# EasyEDA Pro project 智能车.eprj, board PCB3
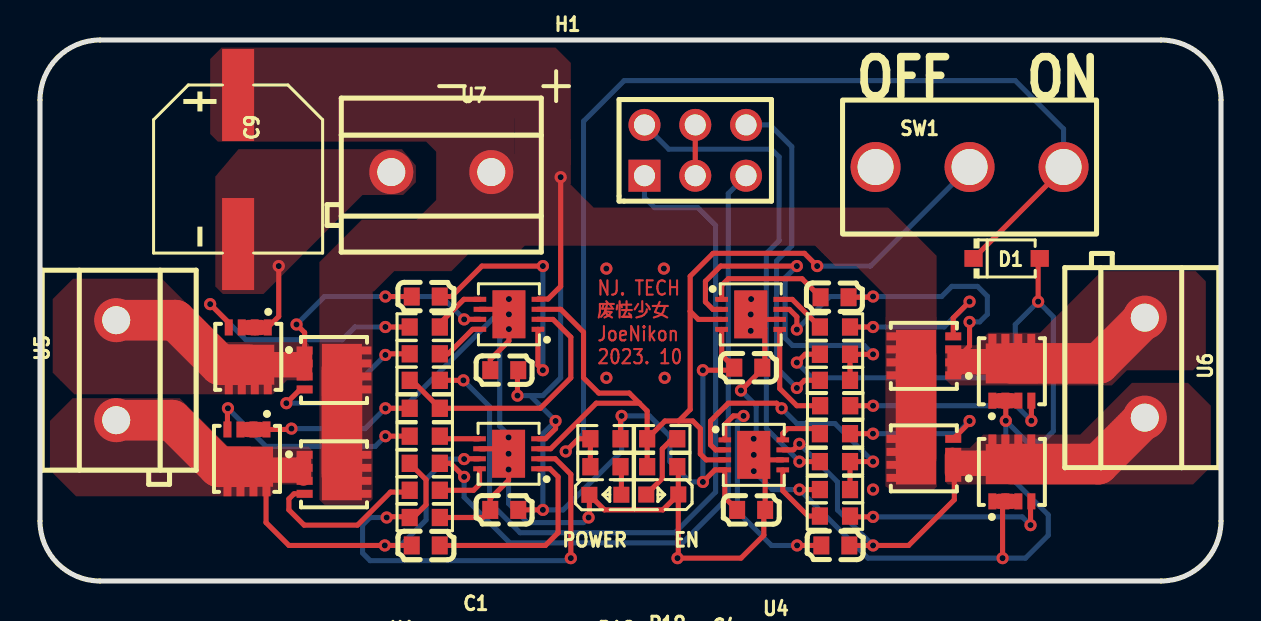
[diagram p12: board, top side]
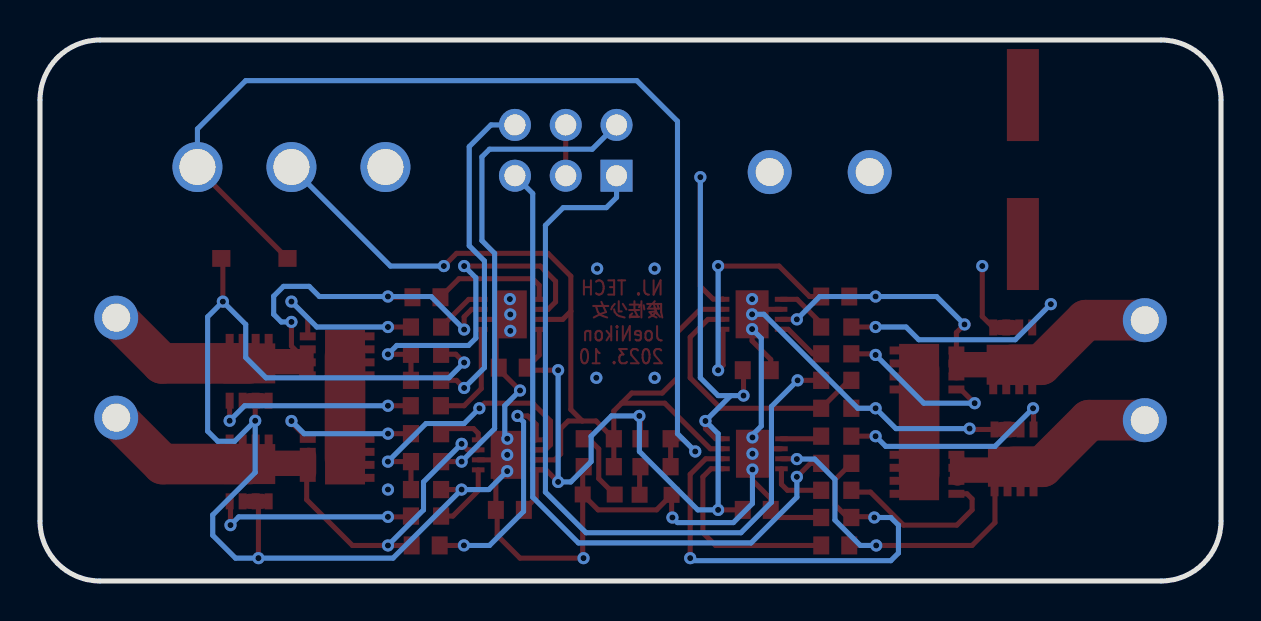
[diagram p13: board, bottom side, seen from below]

Outline 59.05 x 27.05 mm; copper layers: Top Layer, Bottom Layer. Coordinates in mm from the lower left corner of the outline.
Outline path: 0,24.05 0,3 arc(0.88,0.88) 3,0 56.05,0 arc(58.18,0.88) 59.05,3 59.05,24.05 arc(58.18,26.17) 56.05,27.05 3,27.05 arc(0.88,26.17) 0,24.05
Stack: Top Layer 0.035mm / Dielectric1 1.51mm FR4 er 4.5 / Bottom Layer 0.035mm

## Design rules (mm)
template: JLCPCB Capability(Two Layers Board)
spacing copperThickness1oz (default): track to track 0.102, other pairs 0.152 to 0.3
spacing copperThickness2oz: track to track 0.203, other pairs 0.152 to 0.3
track width copperThickness1oz (default): min 0.127, default 0.254, max 2.54
track width copperThickness2oz: min 0.203, default 0.254, max 2.54
differential pair differentialPair (default): width min 0.127, default 0.254, max 2.54; gap min 0.152, default 0.152
via viaSize (default): diameter min 0.5, default 0.61, max 10; hole min 0.3, default 0.305, max 6.3

## Placement (name value [footprint] x y rotation side)
C1  1uF  [C0603]  23.21 10.54 0 top
C2  1uF  [C0603]  23.21 3.56 0 top
C3  1uF  [C0603]  35.56 3.56 180 top
C4  1uF  [C0603]  35.42 10.67 180 top
C5  1uF  [C0603]  19.29 14.22 180 top
C9  220uF  [CAP-SMD_BD8.0-L8.3-W8.3-LS9.3-FD]  9.91 20.57 270 top
C10  1uF  [C0603]  19.29 1.78 180 top
C11  1uF  [C0603]  39.77 1.78 0 top
C12  1uF  [C0603]  39.73 14.19 0 top
D1  BZT52C3V3  [SOD-123_L2.7-W1.7-LS3.8-RD]  48.33 16.13 0 top
EN  -  [LED_0603]  31.07 4.32 180 top
H1  -  [HDR-TH_6P-P2.54-V-R2-C3-S2.54_A2541WV-2X3P]  32.77 21.53 0 top
POWER  -  [LED_0603]  28.32 4.32 0 top
Q9  AON7418  [PDFN-8_L3.3-W3.3-P0.65-BL]  14.7 10.55 270 top
Q10  AON7418  [PDFN-8_L3.3-W3.3-P0.65-BL]  10.41 11.21 180 top
Q11  AON7418  [PDFN-8_L3.3-W3.3-P0.65-BL]  14.7 5.33 270 top
Q12  AON7418  [PDFN-8_L3.3-W3.3-P0.65-BL]  10.35 6.11 180 top
Q13  AON7418  [PDFN-8_L3.3-W3.3-P0.65-BL]  44.2 6.13 90 top
Q14  AON7418  [PDFN-8_L3.3-W3.3-P0.65-BL]  48.6 5.45 0 top
Q15  AON7418  [PDFN-8_L3.3-W3.3-P0.65-BL]  44.2 11.26 90 top
Q16  AON7418  [PDFN-8_L3.3-W3.3-P0.65-BL]  48.6 10.49 0 top
R1  10K  [R0603]  19.24 8.64 0 top
R2  1  [R0603]  19.24 10.03 180 top
R3  10  [R0603]  19.24 11.36 180 top
R4  10  [R0603]  19.24 12.7 0 top
R17  1K  [R0603]  28.27 5.72 180 top
R18  1K  [R0603]  28.27 7.11 0 top
R19  2K  [R0603]  31.11 7.11 0 top
R20  10K  [R0603]  31.11 5.72 0 top
R21  10K  [R0603]  19.24 3.17 180 top
R22  1  [R0603]  19.24 5.88 180 top
R23  10  [R0603]  19.24 4.54 180 top
R24  10  [R0603]  19.24 7.24 0 top
R25  10K  [R0603]  39.75 4.57 0 top
R26  1  [R0603]  39.75 5.97 0 top
R27  10  [R0603]  39.75 7.37 0 top
R28  10  [R0603]  39.75 3.25 180 top
R29  10K  [R0603]  39.75 11.34 0 top
R30  1  [R0603]  39.75 10.03 0 top
R31  10  [R0603]  39.75 12.7 0 top
R32  10  [R0603]  39.76 8.76 180 top
SW1  SS-12D10L5  [SW-TH_SS-12D10L5]  46.48 20.7 0 top
U1  NCP81155MNTXG  [DFN-8_L3.0-W3.0-P0.50-TL-EP]  23.45 13.33 180 top
U2  NCP81155MNTXG  [DFN-8_L3.0-W3.0-P0.50-TL-EP]  23.43 6.36 180 top
U3  NCP81155MNTXG  [DFN-8_L3.0-W3.0-P0.50-TL-EP]  35.69 6.31 0 top
U4  NCP81155MNTXG  [DFN-8_L3.0-W3.0-P0.50-TL-EP]  35.54 13.33 0 top
U5  KF301-5.0-2P  [CONN-TH_P5.00_KF301-5.0-2P]  3.81 10.54 270 top
U6  KF301-5.0-2P  [CONN-TH_P5.00_KF301-5.0-2P]  55.24 10.67 90 top
U7  KF301-5.0-2P  [CONN-TH_P5.00_KF301-5.0-2P]  20.07 20.45 180 top

## Footprints (pads in the part's own frame, mm; a bottom-side part is the same pattern mirrored in y, then rotated)
C0603
  rect 0.8x0.9 smd: 1(-0.7,0) 2(0.7,0)
CAP-SMD_BD8.0-L8.3-W8.3-LS9.3-FD
  rect 4.6x1.6 smd: 1(-3.724,0) 2(3.724,0)
CONN-TH_P5.00_KF301-5.0-2P
  round 2.2 hole 1.4: 1(-2.5,0) 2(2.5,0)
DFN-8_L3.0-W3.0-P0.50-TL-EP
  rect 0.63x0.25 smd: 1(-1.45,0.75) 2(-1.45,0.25) 3(-1.45,-0.25) 4(-1.45,-0.75) 5(1.45,-0.75) 6(1.45,-0.25) 7(1.45,0.25) 8(1.45,0.75)
  rect 1.65x2.4 smd: 9(0,0)
HDR-TH_6P-P2.54-V-R2-C3-S2.54_A2541WV-2X3P
  rect 1.6x1.6 hole 1.05: 1(-2.54,-1.27)
  round 1.6 hole 1.05: 2(-2.54,1.27) 3(0,-1.27) 4(0,1.27) 5(2.54,-1.27) 6(2.54,1.27)
LED_0603
  rect 0.8x0.8 smd: 1(-0.851,-0.01) 2(0.75,-0.005)
PDFN-8_L3.3-W3.3-P0.65-BL
  rect 0.4x0.8 smd: 1(-0.975,-1.47) 2(-0.325,-1.47) 3(0.325,-1.47) 4(0.975,-1.47) 5(0.975,1.47) 6(0.325,1.47) 7(-0.325,1.47) 8(-0.975,1.47)
  rect 2.6x2 smd: 9(-0.004,0.394)
R0603
  rect 0.806x0.864 smd: 1(-0.753,0) 2(0.753,0)
SOD-123_L2.7-W1.7-LS3.8-RD
  rect 0.91x0.84 smd: 1(-1.655,0) 2(1.655,0)
SW-TH_SS-12D10L5
  round 2.5 hole 1.8: 1(-4.7,0) 2(0,0) 3(4.7,0)

## Nets
As in the schematic.

Pads without a net: SW1 1

## Via types
v1: diameter 0.61, hole 0.305, Top Layer to Bottom Layer, 75 vias

## Routing (per net, layer and track width the routed paths; a pad name or vN(x,y) marks a point on that pad's centre or on a via; arc(x,y) is an arc through that point)
3V3: length 54
  Top Layer w0.254: v1(26.29,6.48) 26.92,7.11 R18.1 R17.2 ; D1.1 51.18,20.63 SW1.3
  Bottom Layer w0.254: SW1.3 51.18,22.61 48.77,25.02 29.21,25.02 27.18,22.99 27.18,7.37 v1(26.29,6.48)
GND: length 134.8
  Top Layer w0.254: EN.1 31.15,3.56 28.22,3.56 POWER.1 27.47,3.21 v1(27.43,3.17) ; EN.1 31.92,1.18 v1(31.88,1.14) 35.05,1.14 36.2,2.29 36.2,3.49 C3.1 36.26,5.74 35.94,6.06 ; EN.1 31.92,5.66 R20.2 ; v1(48.29,8.01) 48.29,8.99 Q16.2 ; Q12.1 12.53,7.58 v1(12.57,7.62) ; v1(11.94,15.75) 11.94,13.23 Q10.1 ; R21.1 22.13,3.17 C2.1 22.52,4.12 23.43,5.03 v1(23.43,5.57) v1(23.43,6.36) 23.18,6.61 U2.6 ; 35.79,13.08 v1(35.54,13.33) ; 35.79,13.08 36.24,12.63 36.24,10.54 ; 35.79,13.08 U4.6 ; v1(48.13,1.14) 48.13,3.84 Q14.2 ; v1(35.05,9.52) 36.12,10.59 36.12,10.67 ; C1.1 22.52,11.08 23.45,12.01 v1(23.45,12.59) v1(23.45,13.33) 23.2,13.58 U1.6 ; D1.2 49.91,16.05 v1(49.91,13.97) ; R29.1 38.26,11.34 v1(37.85,10.92) ; 35.94,6.06 U3.6 ; 35.94,6.06 v1(35.69,6.31) ; H1.4 H1.3 ; 18.49,8.63 18.48,8.64 v1(17.27,8.64) ; R25.1 v1(37.97,4.57)
  Top Layer w0.762: 48.58,9.02 48.27,9.02 ; Q16.2 47.96,9.02 ; 48.58,3.98 Q14.2 47.96,3.98 ; 11.05,12.68 Q10.2 10.43,12.68 ; 10.98,7.58 10.36,7.58
  Bottom Layer w0.254: v1(23.45,13.33) 22.86,13.33 18.16,8.64 v1(17.27,8.64) 16.26,7.62 v1(12.57,7.62) ; v1(27.43,3.17) 27.18,2.92 24.38,2.92 23.43,3.88 v1(23.43,5.57) ; v1(35.69,5.49) 36.61,4.57 v1(37.97,4.57) 41.4,1.14 v1(48.13,1.14) 49.28,1.14 50.42,2.29 50.42,3.3 48.29,5.43 v1(48.29,8.01) 49.32,6.98 50.17,6.98 50.67,7.49 50.67,13.21 v1(49.91,13.97) 48.77,12.83 48.77,11.18 47.75,10.16 38.61,10.16 v1(37.85,10.92) ; v1(35.69,7.11) 35.81,7.24 35.81,8.76 v1(35.05,9.52) ; v1(23.43,7.18) 23.43,7.3 22.99,7.75 22.99,12.13 v1(23.45,12.59)
  vias: v1(23.45,14.1) v1(28.32,15.62) v1(28.32,10.16) v1(31.2,15.62) v1(31.24,10.16) v1(35.56,14.1) v1(35.54,12.51) v1(41.66,4.57)
VBAT: length 67.8
  Top Layer w0.254: v1(23.88,9.27) 23.88,10.5 23.92,10.54 ; v1(29.08,8.25) 29.03,8.2 R18.2 ; v1(26.03,20.19) 26.03,14.73 25.4,14.1 24.91,14.1 U1.4 ; v1(33.15,4.95) 33.75,5.56 U3.4 34.24,4.17 C3.2 ; v1(25.15,3.56) 23.92,3.56 ; U2.4 25.27,7.11 25.78,7.62 v1(25.78,8) ; 34.09,12.58 34.09,11.3 34.84,10.54 v1(33.15,10.54)
  Top Layer w2.032: Q15.9 Q13.9 ; Q9.9 Q11.9
  Bottom Layer w0.254: v1(23.88,9.27) 24.51,9.27 ; 24.51,9.27 v1(25.78,8) 25.15,7.37 v1(25.15,3.56) 26.16,3.56 29.08,6.48 v1(29.08,8.25) 30.48,8.25 31.5,7.24 31.5,5.97 32.51,4.95 v1(33.15,4.95) v1(33.15,10.54) ; 24.51,9.27 25.15,9.27 26.03,10.16 v1(26.03,20.19)
EN: length 49.5
  Top Layer w0.254: 29.97,8.89 30.36,8.5 R19.1 ; 29.97,8.89 29.46,9.4 27.94,9.4 27.18,10.16 27.18,12.45 26.04,13.58 U1.3 ; 29.97,8.89 27.81,8.89 25.53,6.61 U2.3 ; 32.51,13.48 32.92,13.08 34.09,13.08 ; 32.51,13.48 32.51,8.58 31.94,8 ; 32.51,13.48 32.51,15.24 33.65,16.38 38.23,16.38 v1(38.86,15.75) ; 31.94,8 31.25,8 R19.1 ; 31.94,8 32.64,8 33.02,7.62 33.02,6.35 33.31,6.06 U3.3 ; R19.1 R20.1
  Bottom Layer w0.254: v1(38.86,15.75) 41.53,15.75 SW1.2
MOTORL+: length 23.9
  Top Layer w0.254: v1(21.21,13.08) 21.21,13.08 U1.7 ; v1(12.83,12.83) 13.23,12.42 Q9.1 ; 18.59,14.1 18.46,14.22 v1(17.27,14.22)
  Top Layer w0.762: 13.23,11.3 Q9.2 13.23,10.41
  Top Layer w1.27: 10.5,10.81 12.95,10.81
  Top Layer w2.032: Q10.9 8.99,10.81 6.76,13.04 U5.1
  Bottom Layer w0.254: v1(12.83,12.83) 14.22,14.22 v1(17.27,14.22) 20.07,14.22 v1(21.21,13.08)
MOTORL-: length 28.1
  Top Layer w0.254: v1(21.21,6.1) 21.23,6.11 U2.7 ; C10.2 v1(17.24,1.78) 12.45,1.78 11.3,2.92 11.3,4.61 Q12.8
  Top Layer w0.762: 13.18,5.14 13.18,6.03
  Top Layer w1.27: 10.44,5.54 12.9,5.54
  Top Layer w2.032: U5.2 6.6,8.04 8.93,5.71 Q12.9
  Bottom Layer w0.254: v1(17.24,1.78) 18.03,1.78 19.3,3.05 19.3,5.08 20.32,6.1 v1(21.21,6.1)
MOTORR+: length 26.5
  Top Layer w0.254: U3.7 37.67,6.56 v1(37.97,6.86) ; Q13.2 45.72,5.75 45.72,4.06 43.43,1.78 v1(41.66,1.78) C11.2
  Top Layer w0.762: 45.62,6.29 45.62,5.4
  Top Layer w1.27: 48.36,5.89 45.9,5.89
  Top Layer w2.032: Q14.9 52.92,5.85 U6.1
  Bottom Layer w0.254: v1(41.66,1.78) 39.88,3.56 39.88,4.95 v1(37.97,6.86)
MOTORR-: length 28.8
  Top Layer w0.254: v1(46.48,12.95) 46.48,11.75 45.75,11.02 Q15.2 ; C12.2 41.62,14.19 v1(41.66,14.22) ; U4.7 37.47,13.58 37.85,13.21 v1(37.85,12.57)
  Top Layer w0.762: 45.75,10.48 45.75,11.37
  Top Layer w1.27: 48.48,10.97 46.03,10.97
  Top Layer w2.032: U6.2 52.96,10.88 Q16.9
  Bottom Layer w0.254: v1(46.48,12.95) 46.99,12.95 47.37,13.33 47.37,14.24 46.88,14.73 45.59,14.73 45.08,14.22 v1(41.66,14.22) 39.5,14.22 v1(37.85,12.57)
PWM1: length 39.1
  Top Layer w0.254: v1(21.17,10.03) R2.1
  Bottom Layer w0.254: v1(21.17,10.03) 22.48,8.73 22.48,3.94 24,2.41 31.75,2.41 33.78,4.44 33.78,17.78 32.89,18.67 30.73,18.67 30.23,19.18 H1.1
PWM2: length 34.1
  Top Layer w0.254: v1(21.21,5.21) 20.53,5.88 R22.1
  Bottom Layer w0.254: H1.5 34.42,19.38 34.42,4.19 32.13,1.91 23.49,1.91 21.21,4.19 v1(21.21,5.21)
PWM3: length 24.6
  Top Layer w0.254: v1(37.97,5.97) R26.1
  Bottom Layer w0.254: v1(37.97,5.97) 36.32,7.62 36.32,16.38 36.96,17.02 36.96,21.21 36.58,21.59 31.44,21.59 H1.2
PWM4: length 16.8
  Top Layer w0.254: R30.1 38.23,10.03 v1(37.85,9.65)
  Bottom Layer w0.254: H1.6 36.5,22.8 37.59,21.72 37.59,16.76 36.83,16 36.83,10.67 v1(37.85,9.65)
$1N1614: length 13.3
  Top Layer w0.254: U1.2 24.9,13.08 25.65,13.08 26.54,12.19 26.54,10.16 25.02,8.64 R1.2 18.6,10.03 R2.2
$1N1615: length 13.1
  Top Layer w0.254: v1(25.15,10.54) 24.9,10.79 U1.1 ; C5.1 20.57,14.22 22.1,15.75 v1(25.15,15.75)
  Bottom Layer w0.254: v1(25.15,15.75) v1(25.15,10.54)
$1N1617: length 2.5
  Top Layer w0.254: U1.8 21.64,12.58 20.41,11.36 R3.1
$1N1618: length 2.7
  Top Layer w0.254: R4.2 19.99,12.88 21.2,14.08 U1.5
$1N4435: length 3.6
  Top Layer w0.254: R19.2 31.62,7.11 31.11,6.6 31.11,5.12 EN.2
$1N4625: length 1.4
  Top Layer w0.254: POWER.2 29.07,5.67 R17.1
$1N5255: length 8.4
  Top Layer w0.254: R3.2 17.33,11.36 v1(17.27,11.3) ; Q9.4 13.01,9.58 v1(12.32,8.89)
  Bottom Layer w0.254: v1(12.32,8.89) 14.86,8.89 v1(17.27,11.3)
$1N5368: length 12.5
  Top Layer w0.254: v1(8.51,13.84) 9.44,12.91 Q10.4 ; v1(17.27,12.7) R4.1
  Bottom Layer w0.254: v1(8.51,13.84) 10.29,12.06 15.11,12.06 15.75,12.7 v1(17.27,12.7)
$1N5752: length 24.3
  Top Layer w0.254: R22.2 19.3,5.06 19.3,3.81 18.67,3.17 R21.2 ; 18.55,3.22 17.38,3.22 v1(17.34,3.17) ; v1(26.54,1.14) 26.54,5.33 25.77,6.11 U2.2
  Bottom Layer w0.254: v1(17.34,3.17) 16.51,3.17 16.13,2.79 16.13,1.4 16.51,1.02 26.42,1.02 v1(26.54,1.14)
$1N5753: length 10.2
  Top Layer w0.254: C10.1 25.27,1.78 25.91,2.41 25.91,5.21 25.5,5.61 U2.1
$1N5755: length 2.9
  Top Layer w0.254: R23.1 21.68,4.54 21.98,4.83 U2.8
$1N5756: length 2
  Top Layer w0.254: U2.5 20.12,7.11 R24.2
$1N5762: length 8.5
  Top Layer w0.254: Q11.4 12.7,4.36 12.45,4.11 12.45,3.56 13.21,2.79 15.87,2.79 17.53,4.44 18.4,4.44 R23.2
$1N5777: length 11.2
  Top Layer w0.254: Q12.4 9.37,8.61 v1(9.4,8.64) ; v1(17.27,7.24) 17.28,7.24 R24.1
  Bottom Layer w0.254: v1(9.4,8.64) 11.3,6.73 16.76,6.73 v1(17.27,7.24)
$1N6155: length 14.3
  Top Layer w0.254: U3.2 33.78,6.56 33.53,6.81 33.53,8 34.42,8.89 36.83,8.89 v1(37.08,8.64) ; v1(41.66,5.97) R26.2 R25.2
  Bottom Layer w0.254: v1(37.08,8.64) 37.85,7.87 39.75,7.87 v1(41.66,5.97)
$1N6156: length 11.7
  Top Layer w0.254: v1(35.18,8.25) 34.67,8.25 34.24,7.83 U3.1 ; C11.1 37.86,1.78 v1(37.86,1.78)
  Bottom Layer w0.254: v1(35.18,8.25) 34.87,7.95 34.87,3.48 36.58,1.78 37.85,1.78 v1(37.86,1.78)
$1N6158: length 2.4
  Top Layer w0.254: U3.8 37.14,7.38 37.38,7.62 38.74,7.62 R27.1
$1N6159: length 3.4
  Top Layer w0.254: U3.5 37.14,4.51 38.41,3.25 R28.2
$1N6165: length 7.5
  Top Layer w0.254: Q13.4 46.48,7.92 v1(46.48,8) ; R27.2 v1(41.65,7.37)
  Bottom Layer w0.254: v1(41.65,7.37) 45.85,7.37 v1(46.48,8)
$1N6180: length 10.4
  Top Layer w0.254: R28.1 40.55,3.21 v1(41.66,3.21) ; v1(49.53,2.79) 49.53,3.94 Q14.4
  Bottom Layer w0.254: v1(41.66,3.21) 49.12,3.21 v1(49.53,2.79)
$1N6558: length 17.9
  Top Layer w0.254: R30.2 R29.2 40.51,11.33 v1(41.66,11.33) ; 34.09,13.58 33.65,13.58 33.27,13.95 33.27,14.99 34.04,15.75 v1(37.85,15.75)
  Bottom Layer w0.254: v1(41.66,11.33) 41.21,11.78 37.63,11.78 37.26,12.14 37.26,15.16 v1(37.85,15.75)
$1N6559: length 6.2
  Top Layer w0.254: 34.09,14.08 34.09,14.78 34.42,15.11 38.11,15.11 C12.1
$1N6561: length 2.6
  Top Layer w0.254: U4.8 37.62,14.08 R31.1
$1N6562: length 5.3
  Top Layer w0.254: R32.2 37.85,8.76 36.99,9.62 U4.5
$1N6568: length 8.6
  Top Layer w0.254: v1(41.66,12.7) R31.2 ; v1(46.48,13.97) 45.67,13.15 Q15.4
  Bottom Layer w0.254: v1(41.66,12.7) 45.21,12.7 v1(46.48,13.97)
$1N6583: length 10.4
  Top Layer w0.254: v1(49.57,8.01) Q16.4 ; v1(41.66,8.76) R32.1
  Bottom Layer w0.254: v1(49.57,8.01) 48.82,8.76 v1(41.66,8.76)

## Copper pours and planes (outline as drawn; the poured copper is in the pictures)
GND on Top Layer: -3.05,30.23 61.34,30.23 61.34,-2.03 -3.05,-2.03
GND on Top Layer: 8.76,21.59 18.8,21.59 18.8,14.35 8.76,14.35
GND on Bottom Layer: -5.72,31.62 63.25,31.62 63.25,-5.46 -5.72,-5.46
VBAT on Top Layer: 8.51,26.67 23.71,26.67 23.71,19.3 8.51,19.3
VBAT on Top Layer: 23.71,24.93 26.54,24.93 26.54,17.01 23.71,17.01
VBAT on Top Layer: 21.54,19.81 44.83,19.81 44.83,4.57 21.54,4.57
VBAT on Top Layer: 42.29,13.21 44.83,13.21 44.83,4.7 42.29,4.7
VBAT on Top Layer: 13.97,22.29 23.75,22.29 23.75,3.81 13.97,3.81
VBAT on Top Layer: 21.97,26.67 26.54,26.67 26.54,20.57 21.97,20.57
MOTORL+ on Top Layer: 0.63,15.11 13.46,15.11 13.46,9.34 0.63,9.34
MOTORL- on Top Layer: 0.5,9.14 13.63,9.14 13.63,4.24 0.5,4.24
MOTORR+ on Top Layer: 45.27,9.91 58.55,9.91 58.55,4.83 45.27,4.83
MOTORR- on Top Layer: 45.27,15.49 58.29,15.49 58.29,9.78 45.27,9.78

## Text on the board
Top Layer: NJ. TECH / 废怯少女 / JoeNikon / 2023. 10 | 注意排针间距！！！
Top Solder Mask Layer: NJ. TECH / 废怯少女 / JoeNikon / 2023. 10
Top Silkscreen Layer: - | + | OFF | ON
